# EasyEDA Pro project BlueberryPi.eprj, board PCB1
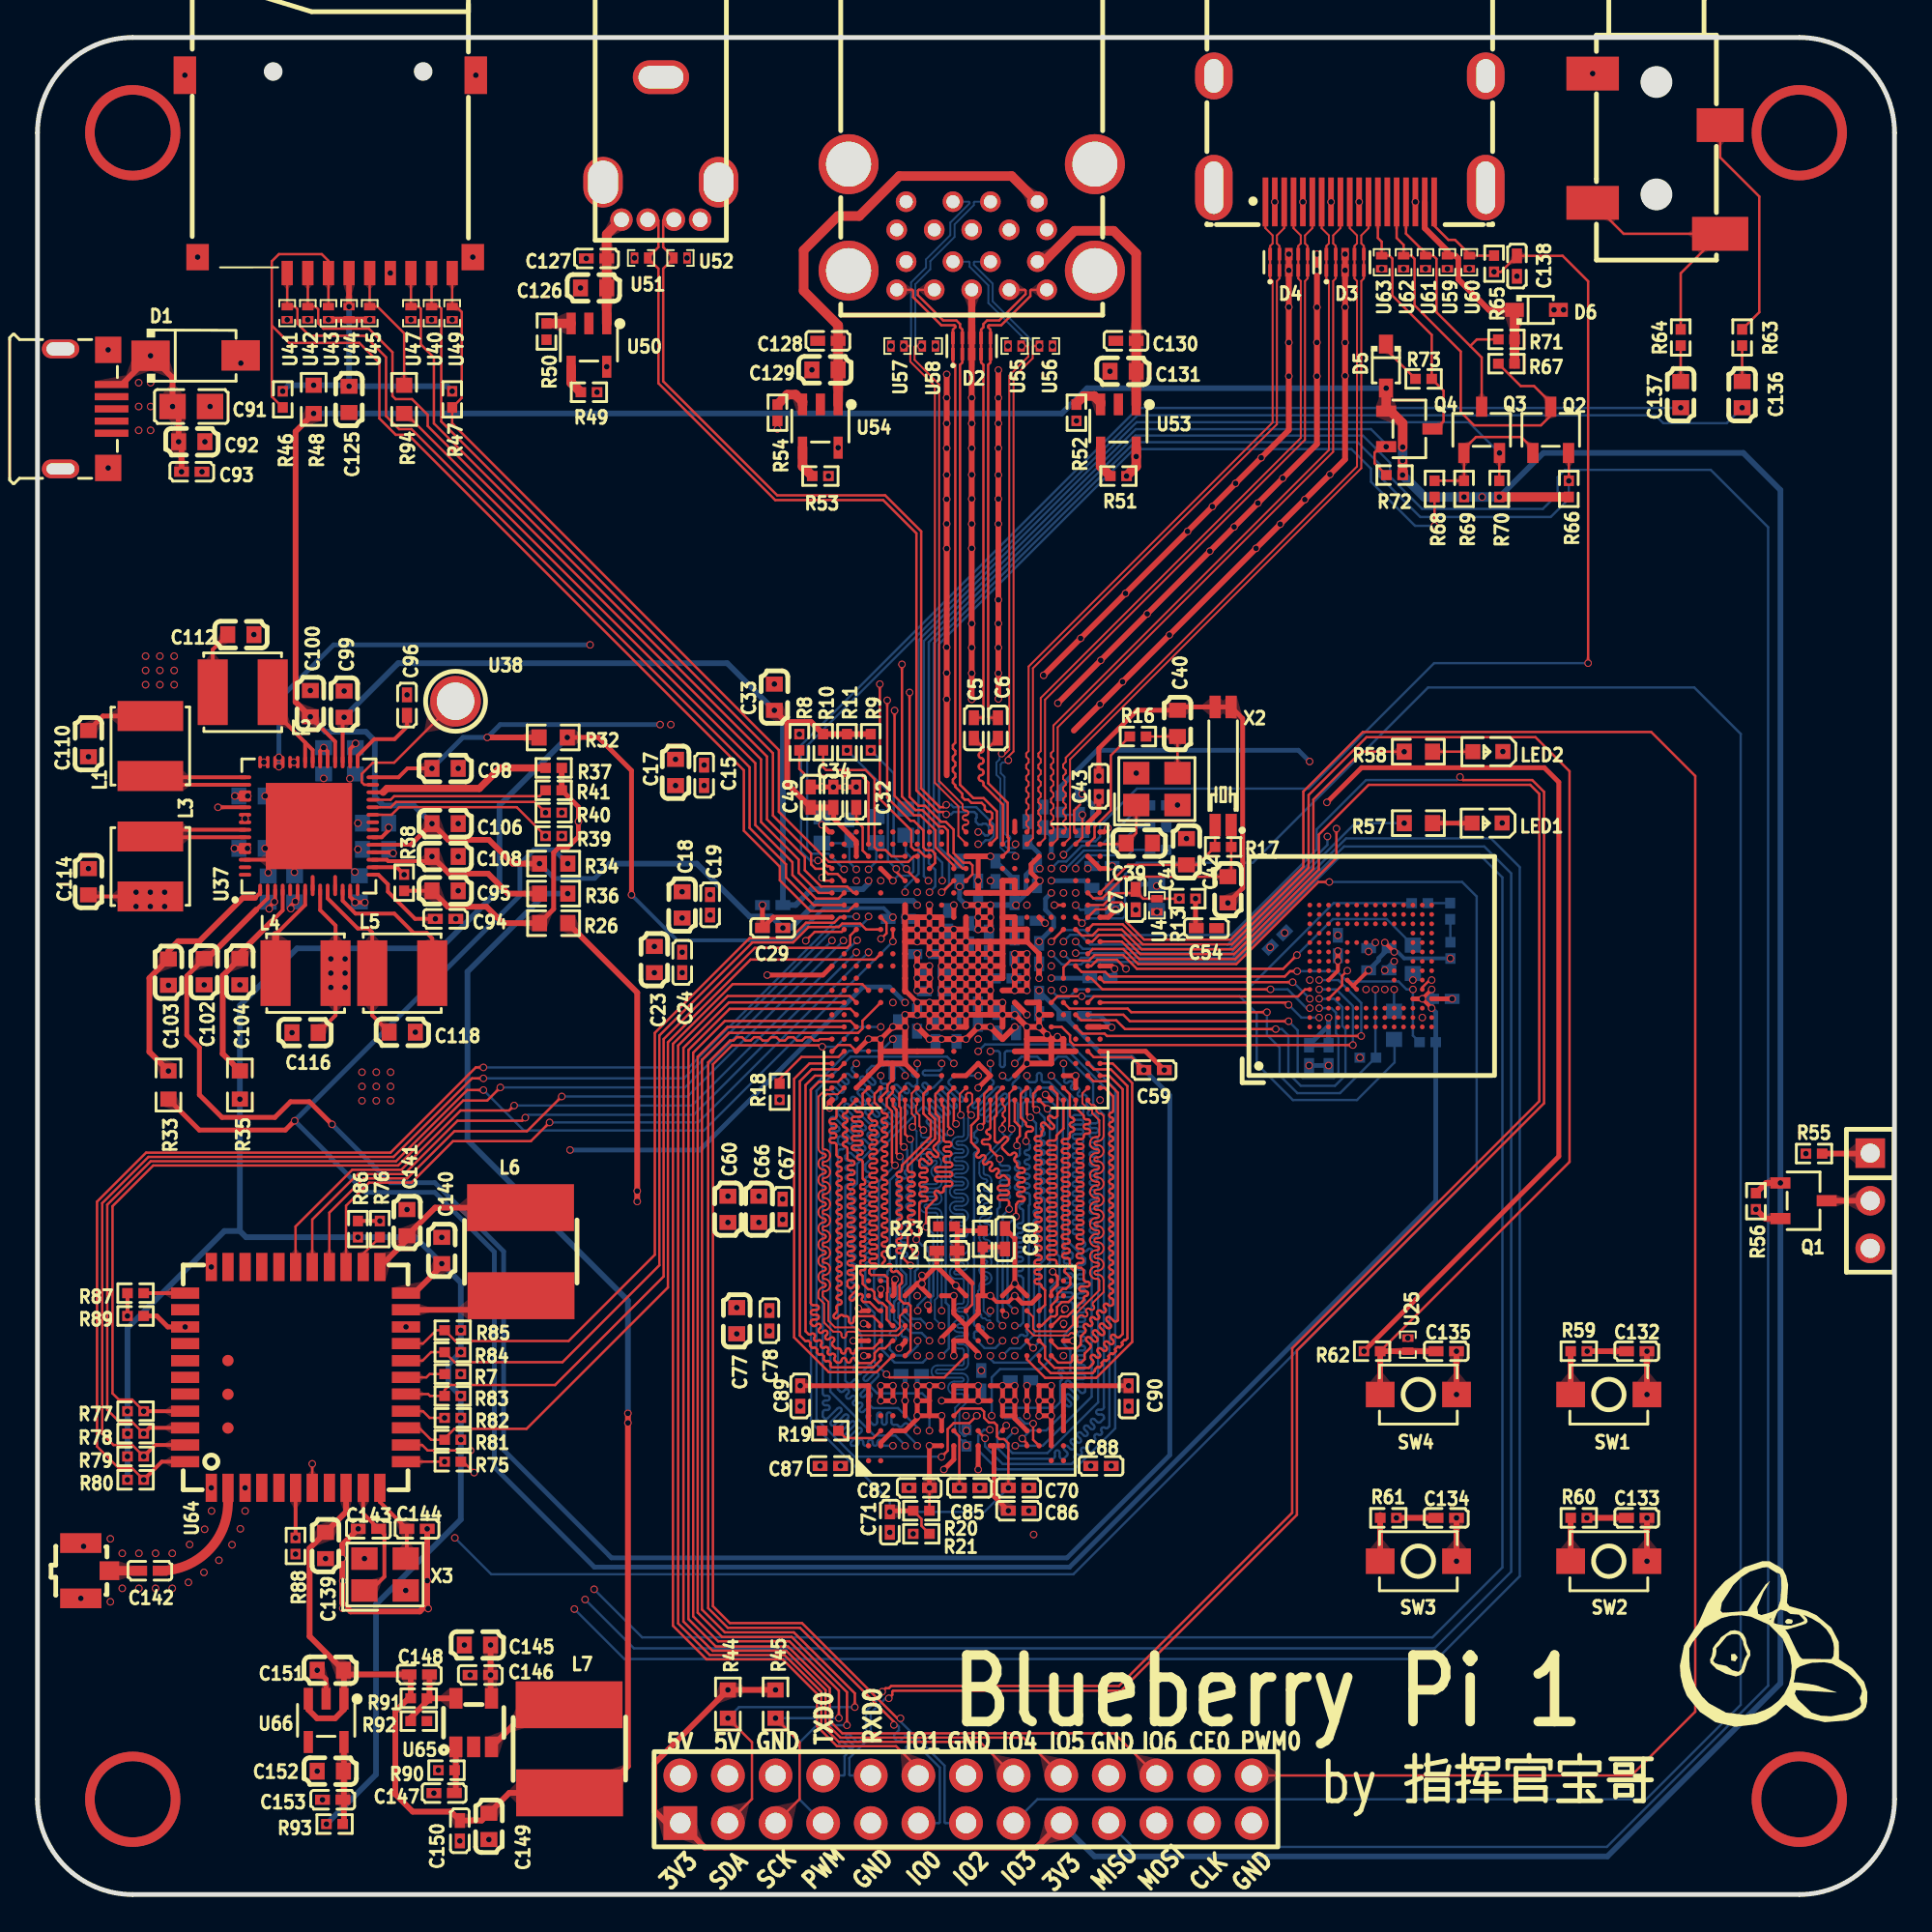
[diagram p13: board, top side]
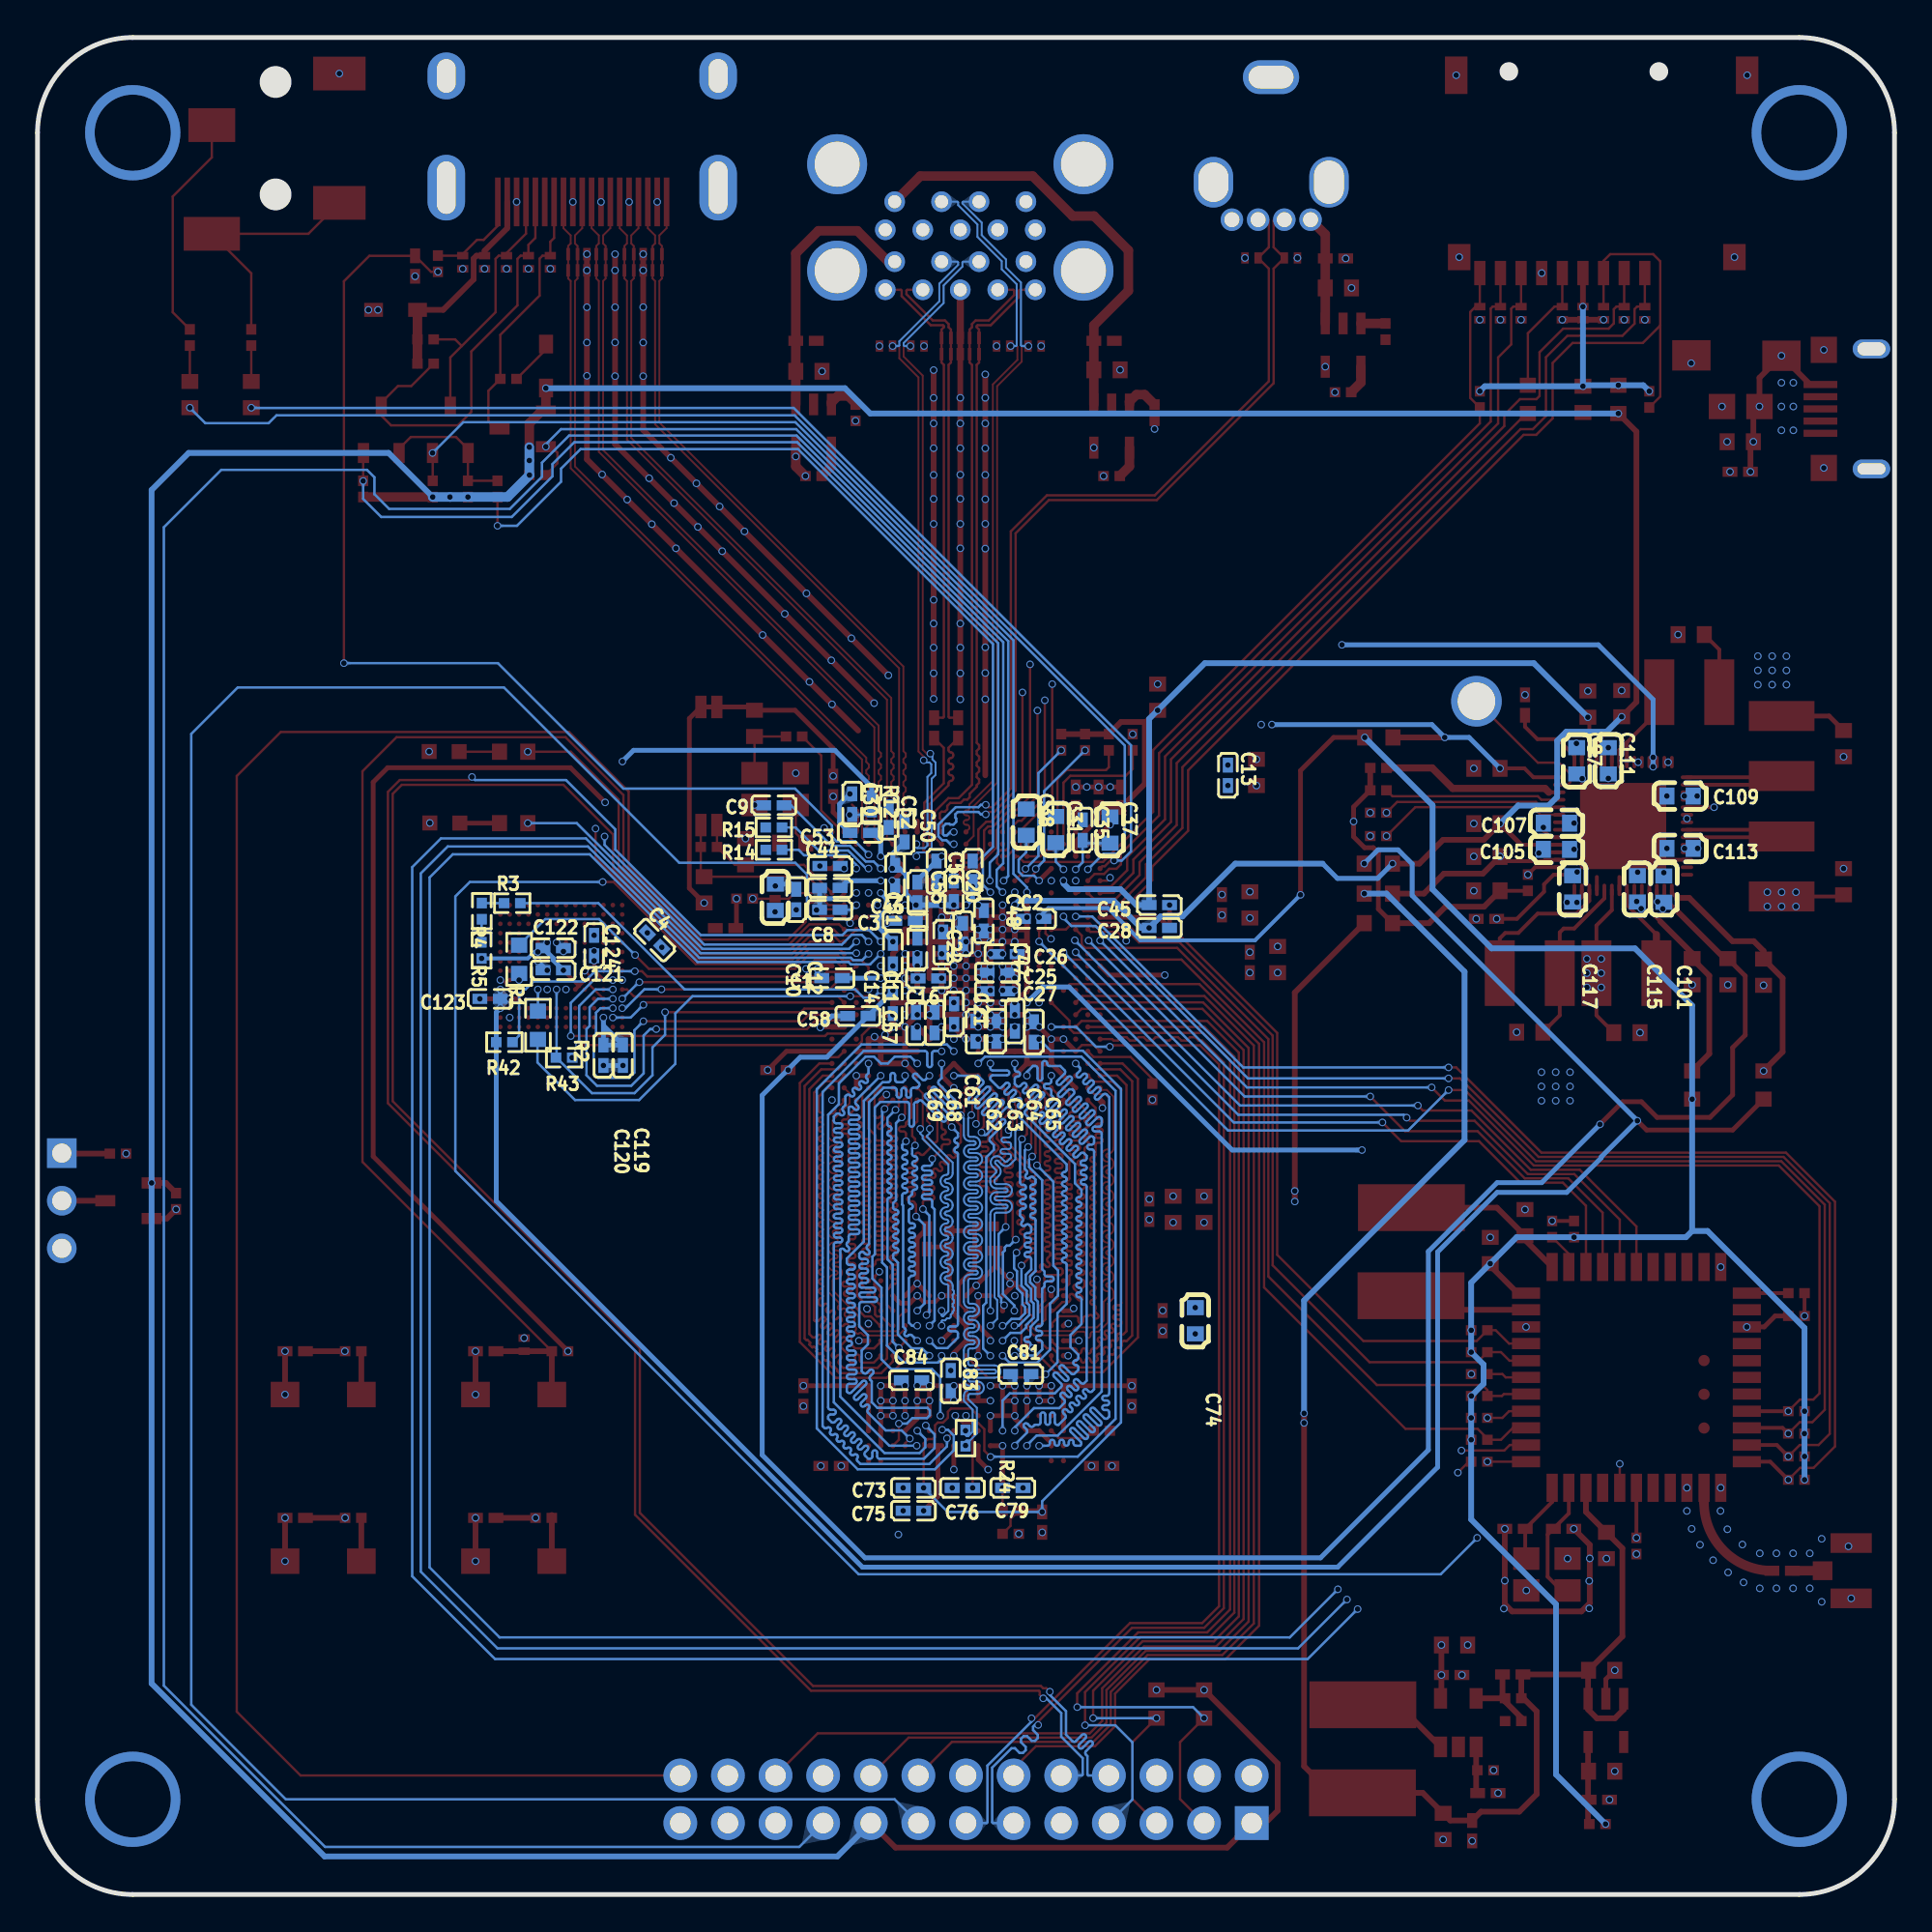
[diagram p14: board, bottom side, seen from below]

Outline 99.06 x 99.06 mm; copper layers: Top Layer, 02GND, 03SIG, 04PWR, 05GND, Bottom Layer. Coordinates in mm from the lower left corner of the outline.
Outline path: 0,93.98 arc(1.49,97.57) 5.08,99.06 93.98,99.06 arc(97.57,97.57) 99.06,93.98 99.06,5.08 arc(97.57,1.49) 93.98,0 5.08,0 arc(1.49,1.49) 0,5.08 0,93.98
Stack: Top Layer 0.035mm / Dielectric1 0.274mm PP er 4.5 / 02GND 0.035mm / Dielectric2 0.274mm PP er 4.5 / 03SIG 0.035mm / Dielectric3 0.274mm FR4 er 4.5 / 04PWR 0.035mm / Dielectric4 0.274mm PP er 4.5 / 05GND 0.035mm / Dielectric5 0.274mm PP er 4.5 / Bottom Layer 0.035mm

## Design rules (mm)
net $C5_2: C2
net USB1-SSTXN: USB1-SSTX
net $C6_2: C2
net USB1-SSTXP: USB1-SSTX
net SCKN: LPDDR-SCK
net SCKP: LPDDR-SCK
net UART3-TX: UART3
net UART3-RX: UART3
net S-UART-RX: S-UART
net S-UART-TX: S-UART
net USB0-DM: USB0-D
net USB0-DP: USB0-D
net HOST3_DM: HOST3-D
net HOST3_DP: HOST3-D
net USB1-DM: USB1-D
net USB1-DP: USB1-D
net USB1-SSRXN: USB1-SSRX
net USB1-SSRXP: USB1-SSRX
net HTX0P: HTX0
net HTX0N: HTX0
net HTXCP: HTXC
net HTXCN: HTXC
net HTX2P: HTX2
net HTX2N: HTX2
net HTX1P: HTX1
net HTX1N: HTX1
net SDQS3P: SDQS3
net SDQS3N: SDQS3
net SDQS2P: SDQS2
net SDQS2N: SDQS2
net SDQS0N: SDQS0
net SDQS1N: SDQS1
net SDQS1P: SDQS1
net SDQS0P: SDQS0
template: 自定义配置
spacing copperThickness1oz (default): track to track 0.102, other pairs 0.089 to 0.3
spacing copperThickness2oz: track to track 0.203, other pairs 0.152 to 0.3
track width copperThickness1oz: min 0.127, default 0.127, max 2.54
track width copperThickness2oz: min 0.203, default 0.305, max 2.54
track width PWR (default): min 0.127, default 0.508, max 2.54
differential pair DP100ohm（外层）: width min 0.102, default 0.102, max 2.54; gap min 0.127, default 0.127
differential pair DP100ohm（内层）: width min 0.102, default 0.102, max 2.54; gap min 0.203, default 0.203
differential pair DP90ohm（外层） (default): width min 0.127, default 0.127, max 2.54; gap min 0.127, default 0.127
differential pair DP90ohm（内层）: width min 0.114, default 0.114, max 2.54; gap min 0.14, default 0.14
via viaSize (default): diameter min 0.399, default 0.399, max 10; hole min 0.3, default 0.3, max 5.999
net SCKN uses DP100ohm（外层）
net SCKP uses DP100ohm（外层）
net HOST3_DM uses DP100ohm（外层）
net HOST3_DP uses DP100ohm（外层）
net USB1-DM uses DP100ohm（外层）
net USB1-DP uses DP100ohm（外层）
net HTX0P uses DP100ohm（外层）
net HTX0N uses DP100ohm（外层）
net HTXCP uses DP100ohm（外层）
net HTXCN uses DP100ohm（外层）
net HTX2P uses DP100ohm（外层）
net HTX2N uses DP100ohm（外层）
net HTX1P uses DP100ohm（外层）
net HTX1N uses DP100ohm（外层）
net SDQS3P uses DP100ohm（外层）
net SDQS3N uses DP100ohm（外层）
net SDQS2P uses DP100ohm（外层）
net SDQS2N uses DP100ohm（外层）
net SDQS0N uses DP100ohm（外层）
net SDQS1N uses DP100ohm（外层）
net SDQS1P uses DP100ohm（外层）
net SDQS0P uses DP100ohm（外层）
diff pair LPDDR-SCK uses DP100ohm（外层）
diff pair HOST3-D uses DP100ohm（外层）
diff pair USB1-D uses DP100ohm（外层）
diff pair HTX0 uses DP100ohm（外层）
diff pair HTXC uses DP100ohm（外层）
diff pair HTX2 uses DP100ohm（外层）
diff pair HTX1 uses DP100ohm（外层）
diff pair SDQS3 uses DP100ohm（外层）
diff pair SDQS2 uses DP100ohm（外层）
diff pair SDQS0 uses DP100ohm（外层）
diff pair SDQS1 uses DP100ohm（外层）

## Placement (name value [footprint] x y rotation side)
AUDIO1  PJ-327C-4A  [AUDIO-SMD_PJ-327C-4A]  86.36 92.86 0 top
C1  100nF  [C0402]  56.68 48.88 180 bottom
C2  100nF  [C0402]  45.92 52.04 180 bottom
C3  100nF  [C0402]  52.78 51.94 0 bottom
C4  100nF  [C0402]  66.14 50.91 225 bottom
C5  100nF  [C0402]  49.95 62.23 270 top
C6  100nF  [C0402]  51.23 62.23 270 top
C7  1nF  [C0402]  58.59 53.07 270 top
C8  1nF  [C0402]  56.79 52.53 0 bottom
C9  1uF  [C0402]  59.78 58.1 0 bottom
C10  4.7uF  [C0603]  59.7 53.2 90 bottom
C11  1uF  [C0402]  53.43 50.19 90 bottom
C12  100nF  [C0402]  58.59 53.07 90 bottom
C13  1uF  [C0402]  35.56 59.7 270 bottom
C14  1uF  [C0402]  52.12 50.47 270 bottom
C15  100nF  [C0402]  35.56 59.7 270 top
C16  100nF  [C0402]  51.54 48.87 0 bottom
C17  10uF  [C0603]  34.04 59.86 270 top
C18  10uF  [C0603]  34.39 52.79 90 top
C19  1uF  [C0402]  35.88 52.79 90 top
C20  1uF  [C0402]  50.18 53.52 270 bottom
C21  100nF  [C0402]  49.69 51.26 90 bottom
C22  100nF  [C0402]  50.75 50.8 90 bottom
C23  10uF  [C0603]  32.91 49.87 90 top
C24  1uF  [C0402]  34.39 49.72 90 top
C25  1uF  [C0402]  47.85 49.17 180 bottom
C26  100nF  [C0402]  47.35 50.17 180 bottom
C27  100nF  [C0402]  47.85 48.18 180 bottom
C28  1uF  [C0402]  39.22 51.56 0 bottom
C29  100nF  [C0402]  39.22 51.56 0 top
C30  100nF  [C0402]  55.6 58.17 270 bottom
C31  4.7uF  [C0603]  44.74 56.81 270 bottom
C32  1uF  [C0402]  43.68 58.53 270 top
C33  10uF  [C0603]  39.31 63.87 270 top
C34  100nF  [C0402]  42.46 58.53 270 top
C35  100nF  [C0402]  43.31 56.78 270 bottom
C37  10uF  [C0603]  41.85 56.78 270 bottom
C38  4.7uF  [C0603]  46.32 57.2 270 bottom
C39  12pF  [C0603]  58.78 56.08 0 top
C40  12pF  [C0603]  60.81 62.47 90 top
C41  7pF  [C0603]  61.29 55.63 90 top
C42  7pF  [C0603]  63.5 53.59 270 top
C43  100nF  [C0402]  56.62 59.12 270 top
C44  220nF  [C0402]  56.78 54.86 180 bottom
C45  100nF  [C0402]  39.22 52.78 0 bottom
C46  100nF  [C0402]  56.79 53.7 180 bottom
C47  100nF  [C0402]  48.58 51.94 90 bottom
C48  100nF  [C0402]  49.17 54.58 270 bottom
C49  100nF  [C0402]  41.25 58.53 270 top
C50  1uF  [C0402]  52.81 56.69 270 bottom
C51  100nF  [C0402]  53.31 54.36 90 bottom
C52  4.7uF  [C0402]  53.66 57.47 270 bottom
C53  100nF  [C0402]  55.17 56.63 180 bottom
C54  100nF  [C0402]  62.36 51.55 180 top
C55  100nF  [C0402]  52.12 53.45 270 bottom
C56  100nF  [C0402]  51.1 54.58 270 bottom
C57  100nF  [C0402]  53.43 47.54 90 bottom
C58  100nF  [C0402]  55.3 46.86 180 bottom
C59  100nF  [C0402]  59.56 43.98 180 top
C60  10uF  [C0603]  36.83 36.55 270 top
C61  1uF  [C0402]  50.16 46.96 270 bottom
C62  100nF  [C0402]  49.02 46.05 270 bottom
C63  100nF  [C0402]  47.9 46.05 270 bottom
C64  100nF  [C0402]  46.92 46.6 270 bottom
C65  100nF  [C0402]  45.91 46.01 270 bottom
C66  100nF  [C0603]  38.48 36.55 270 top
C67  100nF  [C0402]  39.75 36.55 270 top
C68  100nF  [C0402]  51.21 46.51 270 bottom
C69  100nF  [C0402]  52.2 46.51 270 bottom
C70  100nF  [C0402]  52.34 21.69 180 top
C71  100nF  [C0402]  45.47 19.86 90 top
C72  100nF  [C0402]  48.51 34.34 0 top
C73  100nF  [C0402]  52.34 21.69 180 bottom
C74  100nF  [C0603]  37.3 30.61 90 bottom
C75  100nF  [C0402]  52.34 20.47 180 bottom
C76  100nF  [C0402]  49.72 21.69 180 bottom
C77  10uF  [C0603]  37.3 30.61 90 top
C78  1uF  [C0402]  39.04 30.61 90 top
C79  1uF  [C0402]  47.03 21.69 0 bottom
C80  1uF  [C0402]  51.61 34.98 270 top
C81  100nF  [C0402]  46.61 27.76 180 bottom
C82  100nF  [C0402]  47.03 21.69 0 top
C83  100nF  [C0402]  50.34 27.41 270 bottom
C84  100nF  [C0402]  52.44 27.43 0 bottom
C85  100nF  [C0402]  49.72 21.69 180 top
C86  100nF  [C0402]  52.34 20.47 180 top
C87  100nF  [C0402]  42.29 22.86 0 top
C88  100nF  [C0402]  56.73 22.86 180 top
C89  1uF  [C0402]  40.69 26.59 90 top
C90  100nF  [C0402]  58.2 26.59 90 top
C91  22uF  [C0805]  8.2 79.38 180 top
C92  10uF  [C0603]  8.23 77.5 180 top
C93  100nF  [C0402]  8.23 75.89 180 top
C94  1nF  [C0402]  21.77 52.04 180 top
C95  4.7uF  [C0603]  21.74 53.54 180 top
C96  1uF  [C0402]  19.71 63.45 270 top
C97  10uF  [C0603]  16.95 60.48 90 bottom
C98  10uF  [C0603]  21.74 60.07 180 top
C99  10uF  [C0603]  16.36 63.5 270 top
C100  10uF  [C0603]  14.55 63.53 270 top
C101  10uF  [C0603]  12.31 53.63 270 bottom
C102  4.7uF  [C0603]  8.89 49.23 90 top
C103  4.7uF  [C0603]  6.98 49.2 90 top
C104  4.7uF  [C0603]  10.8 49.23 90 top
C105  10uF  [C0603]  18.03 55.75 0 bottom
C106  10uF  [C0603]  21.74 57.12 180 top
C107  10uF  [C0603]  18.03 57.15 0 bottom
C108  10uF  [C0603]  21.74 55.37 180 top
C109  10uF  [C0603]  11.44 58.6 0 bottom
C110  100nF  [C0603]  2.72 61.39 90 top
C111  10uF  [C0603]  15.27 60.48 270 bottom
C112  10uF  [C0603]  10.85 67.21 180 top
C113  10uF  [C0603]  11.44 55.8 0 bottom
C114  10uF  [C0603]  2.72 54.03 270 top
C115  10uF  [C0603]  13.72 53.64 90 bottom
C116  10uF  [C0603]  14.28 45.97 0 top
C117  10uF  [C0603]  17.17 53.64 90 bottom
C118  10uF  [C0603]  19.46 46 180 top
C119  2.2uF  [C0402]  67.83 44.77 90 bottom
C120  100nF  [C0402]  68.87 44.77 90 bottom
C121  100nF  [C0402]  71.55 49.3 180 bottom
C122  100nF  [C0402]  71.55 50.48 0 bottom
C123  100nF  [C0402]  74.92 47.78 180 bottom
C124  100nF  [C0402]  69.37 50.62 270 bottom
C125  100nF  [C0603]  16.62 79.76 90 top
C126  10uF  [C0603]  29.67 85.7 0 top
C127  100nF  [C0402]  29.82 87.27 0 top
C128  100nF  [C0402]  42.16 82.88 0 top
C129  10uF  [C0603]  42.01 81.33 0 top
C130  100nF  [C0402]  58.06 82.88 0 top
C131  10uF  [C0603]  57.91 81.25 0 top
C132  4.7nF  [C0402]  85.31 28.98 180 top
C133  100nF  [C0402]  85.31 20.09 180 top
C134  100nF  [C0402]  75.15 20.09 180 top
C135  470nF  [C0402]  75.15 28.98 180 top
C136  4.7uF  [C0603]  90.93 80.01 90 top
C137  4.7uF  [C0603]  87.66 80.01 90 top
C138  100nF  [C0402]  78.92 86.87 90 top
C139  10uF  [C0603]  15.37 18.62 90 top
C140  4.7uF  [C0603]  21.56 34.35 270 top
C141  4.7uF  [C0603]  19.71 35.84 270 top
C142  10pF  [C0402]  5.99 17.27 0 top
C143  18pF  [C0402]  17.65 19.51 180 top
C144  18pF  [C0402]  20.24 19.51 0 top
C145  10uF  [C0603]  23.47 13.31 0 top
C146  100nF  [C0402]  23.62 11.71 0 top
C147  1uF  [C0402]  21.69 5.41 180 top
C148  22pF  [C0402]  20.37 11.74 180 top
C149  10uF  [C0603]  24.08 3.63 270 top
C150  100nF  [C0402]  22.53 3.4 270 top
C151  100nF  [C0603]  15.62 11.96 0 top
C152  4.7uF  [C0603]  15.62 6.58 0 top
C153  100nF  [C0402]  15.75 5.05 0 top
CARD1  TF-01A  [TF-SMD_TF-01A]  15.62 91.77 180 top
CN1  KH-HDMI-19P-Cu  [HDMI-SMD_KH-HDMI-19P-CU]  70 93.65 180 top
D1  SMAJ5.0A  [SMA_L4.3-W2.6-LS5.0-RD]  8.43 82.09 0 top
D2  AZ1045-04F.R7G  [DFN2510-10_L2.5-W1.0-P0.50-BL]  49.84 82.6 0 top
D3  AZ1045-04F.R7G  [DFN2510-10_L2.5-W1.0-P0.50-BL]  69.75 87.07 0 top
D4  AZ1045-04F.R7G  [DFN2510-10_L2.5-W1.0-P0.50-BL]  66.75 87.07 0 top
D5  1N5819WS  [SOD-323_L1.8-W1.3-LS2.5-RD]  71.93 81.53 270 top
D6  1N5819WS  [SOD-323_L1.8-W1.3-LS2.5-RD]  79.96 84.53 0 top
H1  -  [HDR-TH_3P-P2.54-V-F]  97.76 37.01 270 top
JP1  U.FL-R-SMT-1(80)  [RF-SMD_FRF05002-JSS103M]  3.07 17.27 90 top
L1  1.5uH  [IND-SMD_L4.0-W4.0]  6.02 61.27 90 top
L2  1.5uH  [IND-SMD_L4.0-W4.0]  10.95 64.14 180 top
L3  1.5uH  [IND-SMD_L4.0-W4.0]  6.02 54.84 270 top
L4  1.5uH  [IND-SMD_L4.0-W4.0]  14.3 49.15 0 top
L5  1.5uH  [IND-SMD_L4.0-W4.0]  19.46 49.15 180 top
L6  4.7uH  [IND-SMD_L6.0-W6.0_FNR60XXS]  25.78 34.29 270 top
L7  4.7uH  [IND-SMD_L6.0-W6.0_FNR60XXS]  28.37 7.77 90 top
LED1  -  [LED_0603]  77.28 57.15 180 top
LED2  -  [LED_0603]  77.32 60.96 180 top
Q1  BSN20  [SOT-23-3_L2.9-W1.6-P1.90-LS2.8-BR]  94.21 37.01 180 top
Q2  BSN20  [SOT-23-3_L2.9-W1.6-P1.90-LS2.8-BR]  80.72 78.13 270 top
Q3  BSN20  [SOT-23-3_L2.9-W1.6-P1.90-LS2.8-BR]  77.04 78.13 270 top
Q4  BSN20  [SOT-23-3_L2.9-W1.6-P1.90-LS2.8-BR]  73.18 78.18 180 top
R1  33Ω  [R0603]  73.37 49.89 90 bottom
R2  33Ω  [R0603]  72.36 46.37 270 bottom
R3  0Ω  [R0402]  73.74 52.88 180 bottom
R4  10kΩ  [R0402]  75.36 52.46 90 bottom
R5  1kΩ  [R0402]  75.37 50.36 90 bottom
R7  33Ω  [R0402]  22.15 27.76 180 top
R8  6.04kΩ  [R0402]  40.64 61.47 270 top
R9  2kΩ  [R0402]  44.45 61.47 90 top
R10  2kΩ  [R0402]  41.91 61.47 90 top
R11  10kΩ  [R0402]  43.18 61.47 90 top
R12  1kΩ  [R0402]  54.56 58.18 90 bottom
R13  10kΩ  [R0402]  61.34 53.12 180 top
R14  150kΩ  [R0402]  59.78 55.73 0 bottom
R15  10kΩ  [R0402]  59.78 56.92 0 bottom
R16  0Ω  [R0402]  58.7 61.77 0 top
R17  10K  [R0402]  63.25 55.88 180 top
R18  240Ω  [R0402]  39.59 42.82 90 top
R19  240Ω  [R0402]  42.29 24.74 180 top
R20  2kΩ  [R0402]  47.15 20.47 0 top
R21  2kΩ  [R0402]  47.15 19.24 0 top
R22  1.5kΩ  [R0402]  50.42 34.98 270 top
R23  2kΩ  [R0402]  48.49 35.64 0 top
R24  100Ω  [R0402]  49.56 24.35 270 bottom
R26  0Ω  [R0603]  27.53 51.82 0 top
R32  NC-0Ω  [R0603]  27.51 61.72 180 top
R33  0Ω  [R0603]  6.98 43.18 90 top
R34  NC-0Ω  [R0603]  27.53 54.99 180 top
R35  0Ω  [R0603]  10.8 43.18 90 top
R36  NC-0Ω  [R0603]  27.53 53.39 0 top
R37  0Ω  [R0402]  27.53 60.1 180 top
R38  2kΩ  [R0402]  19.56 53.98 90 top
R39  2kΩ  [R0402]  27.53 56.46 0 top
R40  2kΩ  [R0402]  27.53 57.71 0 top
R41  0Ω  [R0402]  27.53 58.9 180 top
R42  10kΩ  [R0402]  74.16 45.47 180 bottom
R43  10kΩ  [R0402]  70.97 44.64 0 bottom
R44  2kΩ  [R0603]  36.83 10.16 90 top
R45  2kΩ  [R0603]  39.37 10.16 90 top
R46  10kΩ  [R0402]  13.08 79.76 90 top
R47  47kΩ  [R0402]  22.12 79.76 90 top
R48  0Ω  [R0603]  14.73 79.76 90 top
R49  10kΩ  [R0402]  29.42 80.14 180 top
R50  6.8kΩ  [R0402]  27.15 83.37 270 top
R51  10kΩ  [R0402]  57.66 75.67 180 top
R52  6.8kΩ  [R0402]  55.42 79.05 270 top
R53  10kΩ  [R0402]  41.76 75.67 180 top
R54  6.8kΩ  [R0402]  39.47 79.05 270 top
R55  0Ω  [R0402]  94.77 39.52 0 top
R56  10kΩ  [R0402]  91.67 36.98 90 top
R57  330Ω  [R0603]  73.66 57.15 0 top
R58  330Ω  [R0603]  73.66 60.96 0 top
R59  1kΩ  [R0402]  82.22 28.98 0 top
R60  1kΩ  [R0402]  82.22 20.09 0 top
R61  1kΩ  [R0402]  72.06 20.09 0 top
R62  10kΩ  [R0402]  71.19 28.98 180 top
R63  0Ω  [R0402]  90.93 83.06 90 top
R64  0Ω  [R0402]  87.66 83.06 90 top
R65  10kΩ  [R0402]  77.7 87 90 top
R66  10kΩ  [R0402]  81.69 74.98 270 top
R67  1.8kΩ  [R0402]  78.36 81.66 0 top
R68  0Ω  [R0402]  74.52 74.98 90 top
R69  10K  [R0402]  76.1 74.98 90 top
R70  10kΩ  [R0402]  77.98 74.98 270 top
R71  1.8kΩ  [R0402]  78.36 82.96 0 top
R72  56kΩ  [R0402]  72.39 75.72 0 top
R73  56kΩ  [R0402]  73.94 80.85 180 top
R75  100kΩ  [R0402]  22.15 23.09 180 top
R76  0Ω  [R0402]  18.26 35.5 90 top
R77  10kΩ  [R0402]  5.23 25.78 180 top
R78  10kΩ  [R0402]  5.23 24.59 180 top
R79  10kΩ  [R0402]  5.23 23.37 180 top
R80  10kΩ  [R0402]  5.23 22.12 180 top
R81  10kΩ  [R0402]  22.15 24.26 0 top
R82  10kΩ  [R0402]  22.15 25.43 0 top
R83  10kΩ  [R0402]  22.15 26.59 0 top
R84  10kΩ  [R0402]  22.15 28.93 0 top
R85  10kΩ  [R0402]  22.15 30.1 0 top
R86  10kΩ  [R0402]  17.09 35.5 270 top
R87  0Ω  [R0402]  5.23 32.08 180 top
R88  100kΩ  [R0402]  13.77 18.59 90 top
R89  100kΩ  [R0402]  5.23 30.86 180 top
R90  1kΩ  [R0402]  21.82 6.63 0 top
R91  150kΩ  [R0402]  20.34 10.47 180 top
R92  33kΩ  [R0402]  20.34 9.25 0 top
R93  0Ω  [R0402]  15.85 3.76 180 top
R94  33Ω  [R0603]  19.56 79.76 90 top
SW1  TS342A2P-WZ  [SW-SMD_L4.0-W2.9-LS5.0]  83.82 26.67 180 top
SW2  TS342A2P-WZ  [SW-SMD_L4.0-W2.9-LS5.0]  83.82 17.78 180 top
SW3  TS342A2P-WZ  [SW-SMD_L4.0-W2.9-LS5.0]  73.66 17.78 180 top
SW4  TS342A2P-WZ  [SW-SMD_L4.0-W2.9-LS5.0]  73.66 26.67 180 top
U1  -  [BGA451_ALLWINNER_H6]  49.53 49.53 0 top
U4  -  [DFN1006-2L_L1.0-W0.6-P0.70-BI]  59.72 52.77 90 top
U7  MTP125-1213S1  [HDR-TH_26P-P2.54-V-M-R2-C13-S2.54]  49.53 5.08 0 top
U25  -  [DFN1006-2L_L1.0-W0.6-P0.70-BI]  73.1 29.33 270 top
U35  -  [FBGA-178_L11.5-W11.0_K4E6E304EC-TL]  49.53 27.94 90 top
U37  -  [QFN-56_L7.0-W7.0-P0.40-TL-EP4.6]  14.48 57 90 top
U38  TP-红色测试点  [TESTPOINT-TH_BD3.2]  22.3 63.65 0 top
U39  KLMAG1JETD-B041  [FBGA-153_L13.0-W11.5-P0.50_KLMAG1JETD-B041]  71.12 49.53 90 top
U40  -  [DFN1006-2L_L1.0-W0.6-P0.70-BI]  21.02 84.35 90 top
U41  -  [DFN1006-2L_L1.0-W0.6-P0.70-BI]  13.32 84.35 90 top
U42  -  [DFN1006-2L_L1.0-W0.6-P0.70-BI]  14.42 84.35 90 top
U43  -  [DFN1006-2L_L1.0-W0.6-P0.70-BI]  15.52 84.35 90 top
U44  -  [DFN1006-2L_L1.0-W0.6-P0.70-BI]  16.62 84.35 90 top
U45  -  [DFN1006-2L_L1.0-W0.6-P0.70-BI]  17.72 84.35 90 top
U47  -  [DFN1006-2L_L1.0-W0.6-P0.70-BI]  19.92 84.35 90 top
U49  -  [DFN1006-2L_L1.0-W0.6-P0.70-BI]  22.12 84.35 90 top
U50  SY6280AAC  [SOT-23-5_L3.0-W1.7-P0.95-LS2.8-BL]  29.42 82.65 180 top
U51  -  [DFN1006-2L_L1.0-W0.6-P0.70-BI]  32.2 87.3 0 top
U52  -  [DFN1006-2L_L1.0-W0.6-P0.70-BI]  34.3 87.3 180 top
U53  SY6280AAC  [SOT-23-5_L3.0-W1.7-P0.95-LS2.8-BL]  57.66 78.33 180 top
U54  SY6280AAC  [SOT-23-5_L3.0-W1.7-P0.95-LS2.8-BL]  41.76 78.33 180 top
U55  -  [DFN1006-2L_L1.0-W0.6-P0.70-BI]  52.12 82.6 0 top
U56  -  [DFN1006-2L_L1.0-W0.6-P0.70-BI]  53.8 82.6 180 top
U57  -  [DFN1006-2L_L1.0-W0.6-P0.70-BI]  45.87 82.6 0 top
U58  -  [DFN1006-2L_L1.0-W0.6-P0.70-BI]  47.55 82.6 180 top
U59  -  [DFN1006-2L_L1.0-W0.6-P0.70-BI]  75.21 87.07 90 top
U60  -  [DFN1006-2L_L1.0-W0.6-P0.70-BI]  76.38 87.07 90 top
U61  -  [DFN1006-2L_L1.0-W0.6-P0.70-BI]  74.04 87.07 90 top
U62  -  [DFN1006-2L_L1.0-W0.6-P0.70-BI]  72.87 87.07 90 top
U63  -  [DFN1006-2L_L1.0-W0.6-P0.70-BI]  71.7 87.07 90 top
U64  2.4GHz  [QFN-44_L12.0-W12.0-P0.90-TL_AP6212]  13.77 27.58 90 top
U65  SY8089A1AAC  [TSOT-23-5_L2.9-W1.6-P0.95-LS2.8-BR]  23.27 9.17 270 top
U66  ME6212C18M5G  [SOT-23-5_L3.0-W1.7-P0.95-LS2.8-BL]  15.4 9.29 180 top
USB1  U-F-M5DS-Y-1  [MICRO-USB-SMD_U-F-M5DS-Y-1]  2.59 79.25 180 top
USB2  906-162A1011D10200  [USB-A-TH_4P-P1.40-V-F-C39416]  33.25 93.14 180 top
USB3  USB-303WSD-BRY  [USB-A-TH_XUNPU_USB-303WSD-BRY]  49.84 88.95 180 top
X1  24MHz  [CRYSTAL-SMD_4P-L3.2-W2.5-BL]  59.71 58.97 0 top
X2  32.768kHz  [MC-146_4P-L6.7-W1.5-P0.85-TL]  63.25 60.2 90 top
X3  26MHz  [CRYSTAL-SMD_4P-L3.2-W2.5-BL]  18.54 17.07 0 top
